# EasyEDA Pro project 第十四届蓝桥杯EDA国赛练习2.eprj, board PCB
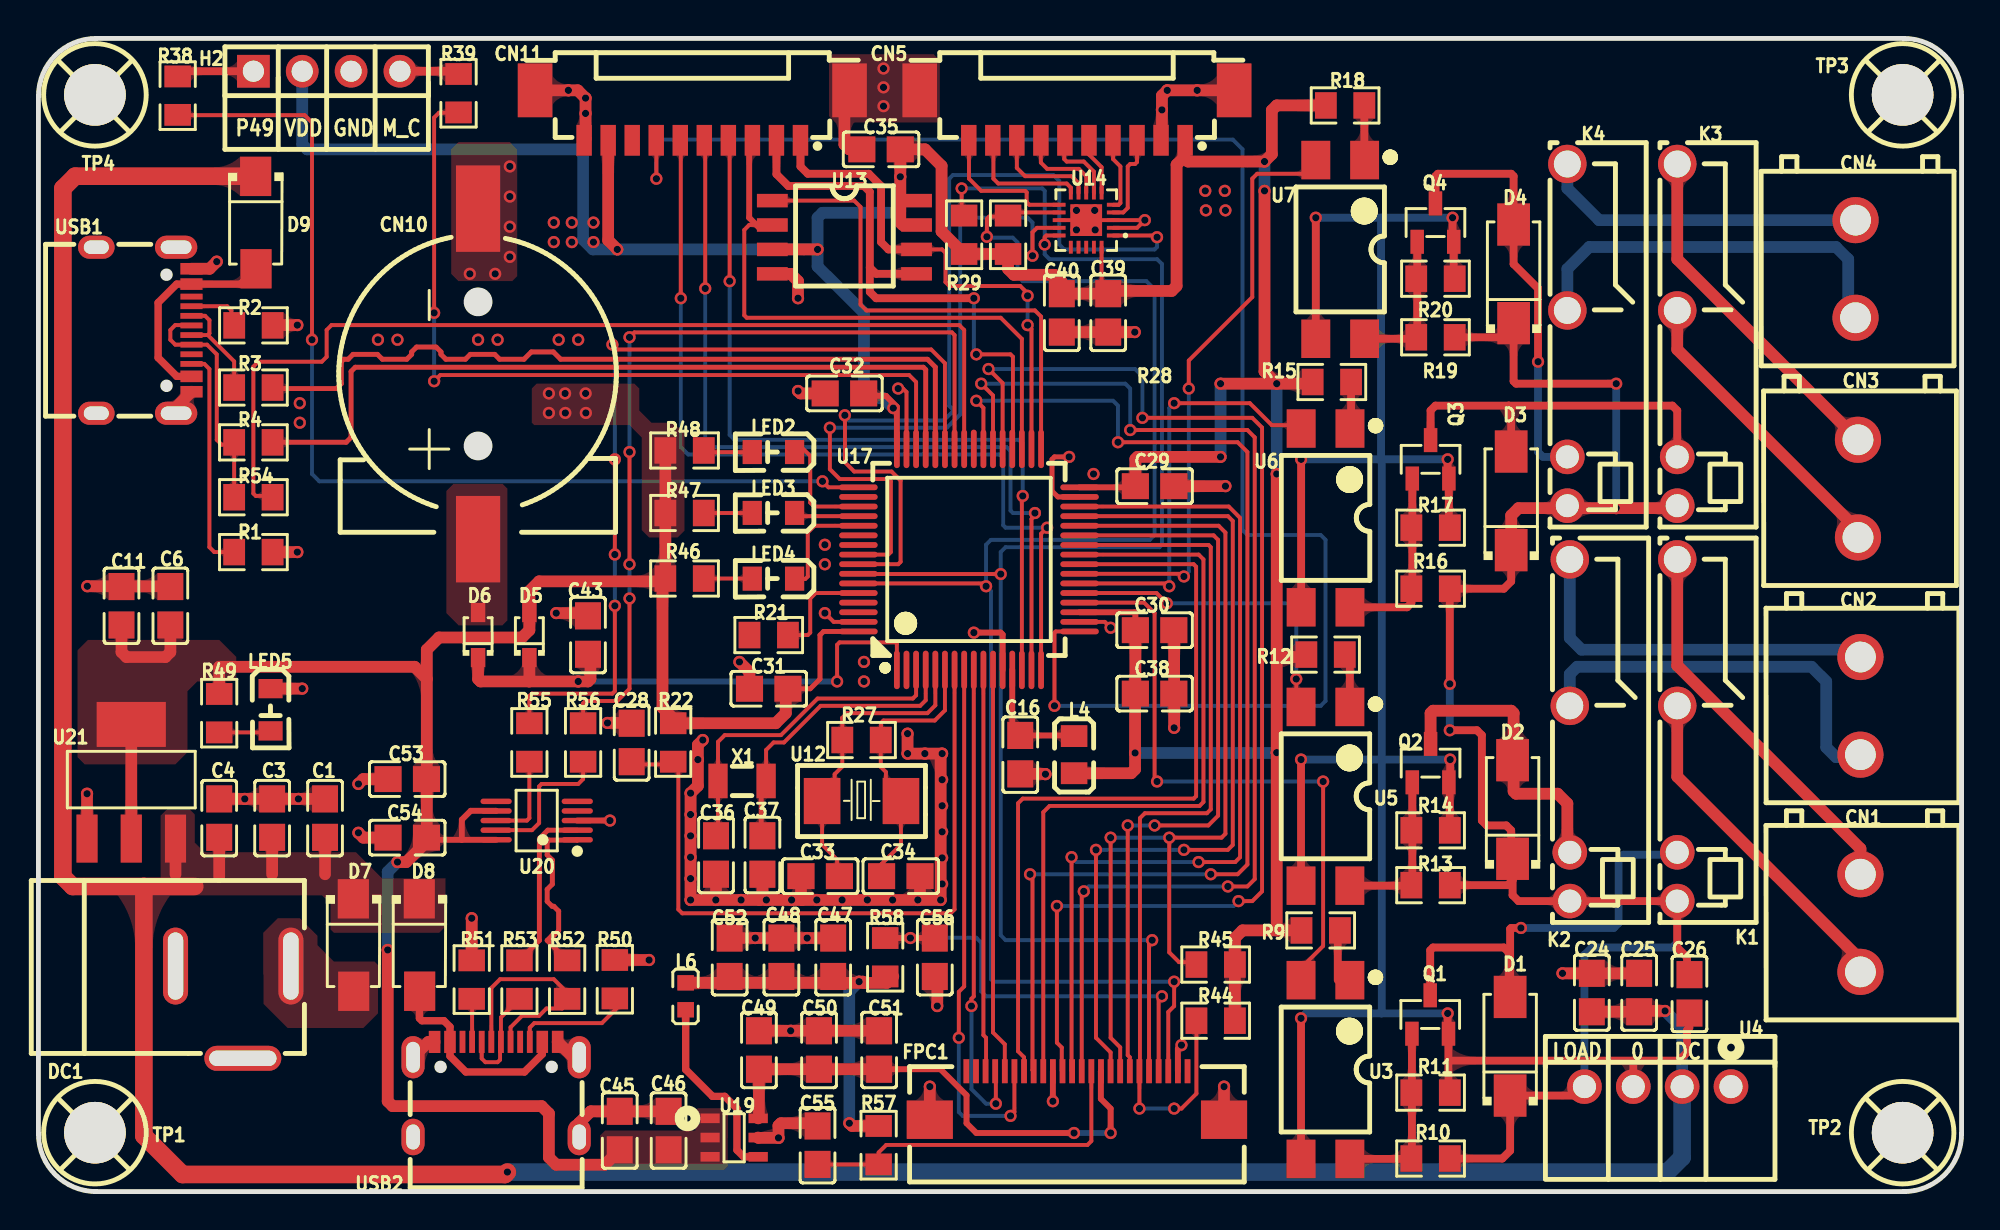
[diagram p3: board, top side]
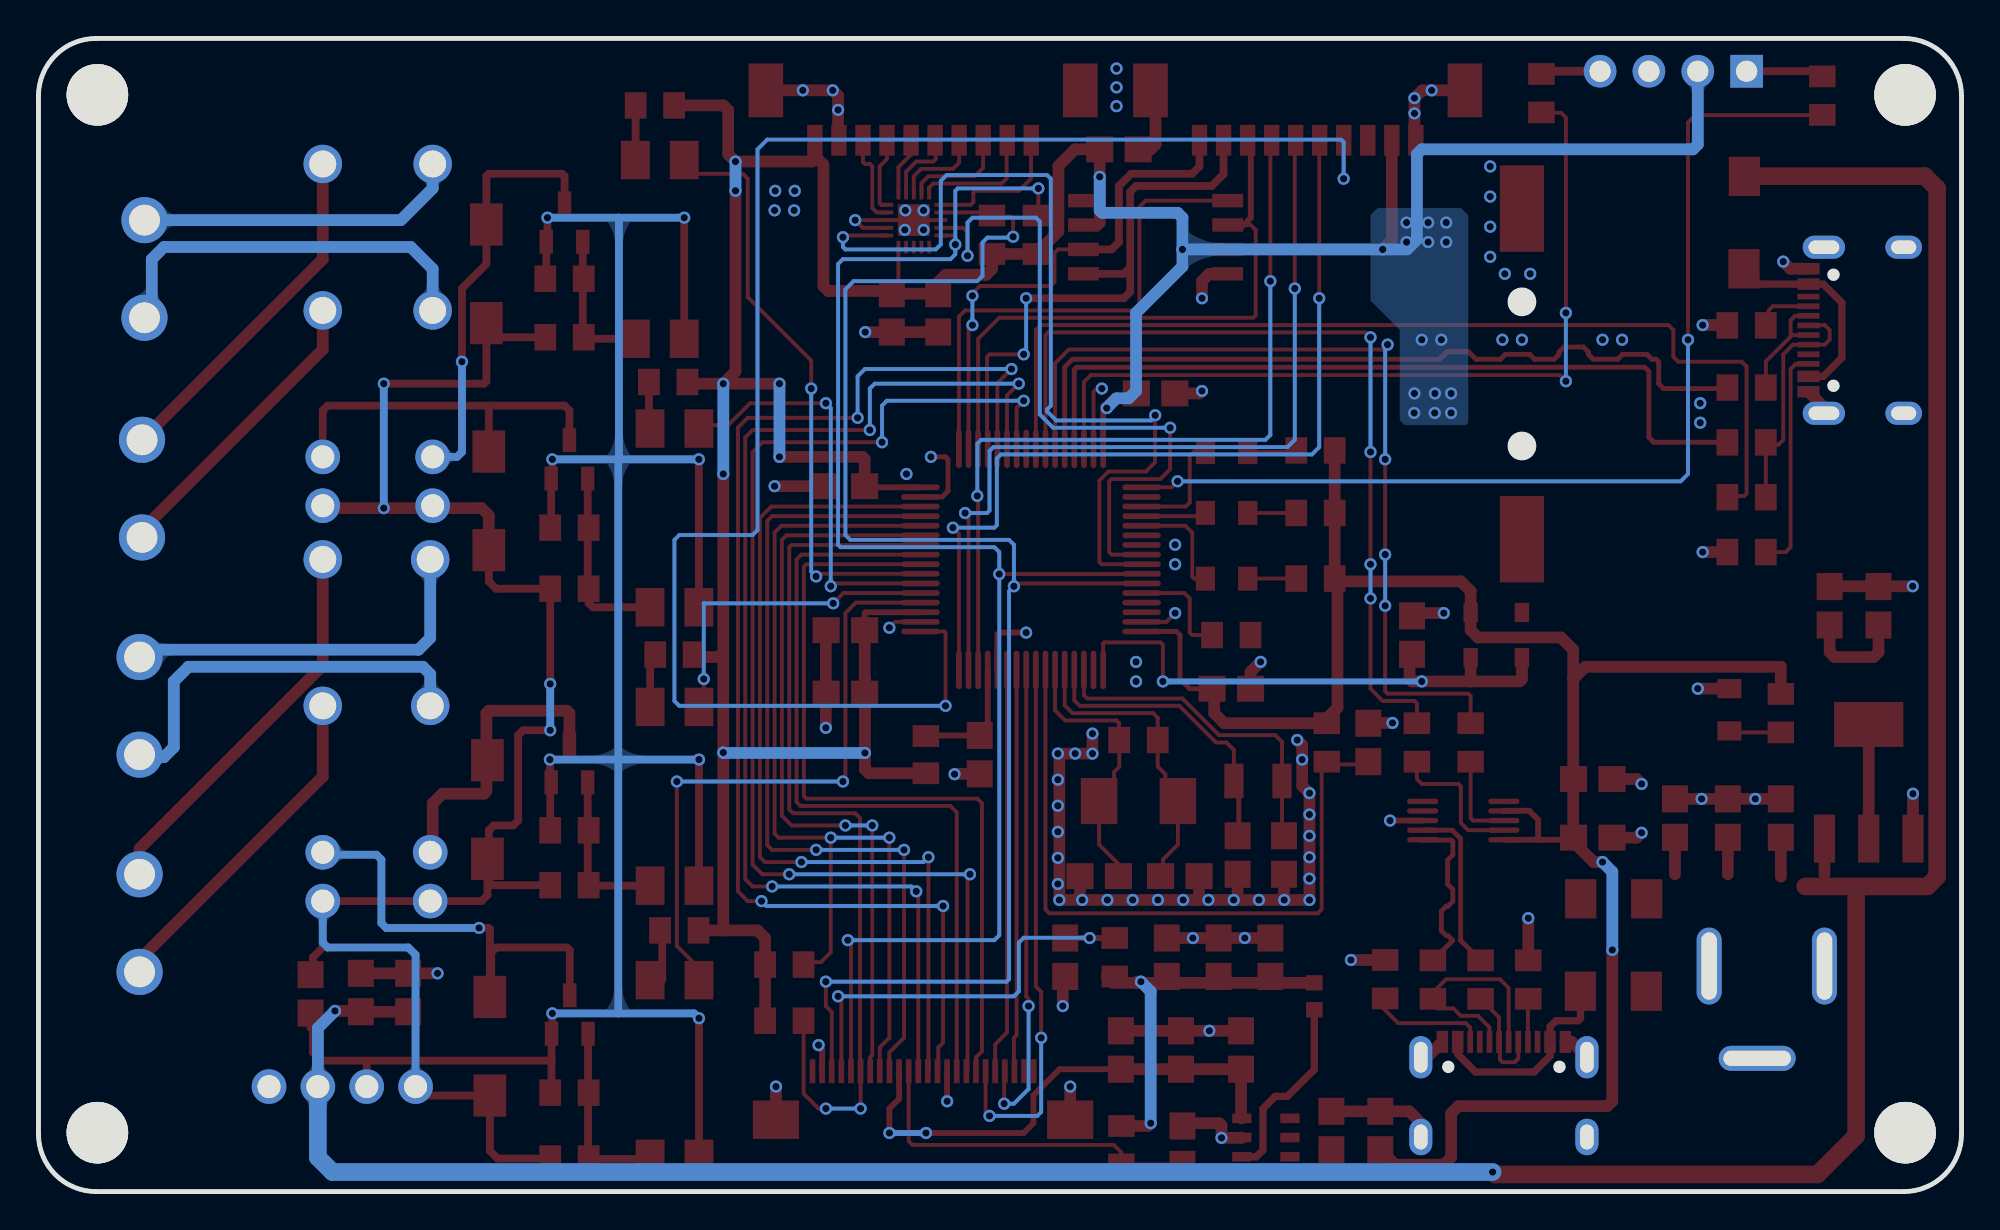
[diagram p4: board, bottom side, seen from below]

Outline 100 x 60 mm; copper layers: Top Layer, Bottom Layer. Coordinates in mm from the lower left corner of the outline.
Outline path: 0,57 arc(0.88,59.12) 3,60 97,60 arc(99.12,59.12) 100,57 100,3 arc(99.12,0.88) 97,0 3,0 arc(0.88,0.88) 0,3 0,57
Stack: Top Layer 0.035mm - / Dielectric1 1.51mm FR4 er 4.5 / Bottom Layer 0.035mm -

## Design rules (mm)
net USB_DN1: DP1
net USB_DP1: DP1
net USB_DP2: DP2
net USB_DN2: DP2
template: 自定义配置
spacing copperThickness1oz (default): track to track 0.178, other pairs 0.152 to 0.203
spacing copperThickness2oz: track to track 0.203, other pairs 0.152 to 0.3
track width copperThickness1oz (default): min 0.203, default 0.203, max 2.54
track width copperThickness2oz: min 0.203, default 0.254, max 2.54
track width PWR: min 0.203, default 0.61, max 2.54
differential pair differentialPair (default): width min 0.127, default 0.254, max 2.54; gap min 0.152, default 0.152
via viaSize (default): diameter min 0.635, default 0.635, max 10; hole min 0.381, default 0.381, max 6.299
net GND uses PWR
net DC uses PWR
net VDD uses PWR
net +2V8 uses PWR
net +1V5 uses PWR
net VDDA uses PWR

## Placement (name value [footprint] x y rotation side)
C1  10uF  [C0805]  14.9 19.43 270 top
C3  10uF  [C0805]  12.15 19.43 270 top
C4  100nF  [C0805]  9.4 19.43 270 top
C6  100nF  [C0805]  6.86 30.48 270 top
C11  10uF  [C0805]  4.32 30.48 270 top
C16  0.1u  [C0805]  51.05 22.73 90 top
C24  4.7uF  [C0805]  80.78 10.36 270 top
C25  4.7uF  [C0805]  83.24 10.36 270 top
C26  10uF  [C0805]  85.85 10.29 270 top
C28  100nF  [C0805]  30.85 23.37 90 top
C29  100nF  [C0805]  58.04 36.7 0 top
C30  100nF  [C0805]  58.04 29.21 0 top
C31  100nF  [C0805]  37.97 26.16 180 top
C32  100nF  [C0805]  41.91 41.53 180 top
C33  20p  [C0805]  40.65 16.41 0 top
C34  20p  [C0805]  44.84 16.41 180 top
C35  100nF  [C0805]  43.81 54.23 0 top
C36  20p  [C0805]  35.23 17.51 90 top
C37  20p  [C0805]  37.65 17.51 90 top
C38  100nF  [C0805]  58.04 25.91 0 top
C39  10uF  [C0805]  55.63 45.72 270 top
C40  100nF  [C0805]  53.21 45.72 90 top
C43  100nF  [C0805]  28.57 28.96 90 top
C45  10uF  [C0805]  30.23 3.18 270 top
C46  10uF  [C0805]  32.77 3.18 270 top
C47  10uF  [C0805]  41.32 12.19 270 top
C48  10uF  [C0805]  38.63 12.19 270 top
C49  10uF  [C0805]  37.47 7.37 90 top
C50  10uF  [C0805]  40.59 7.37 90 top
C51  100nF  [C0805]  43.71 7.37 90 top
C52  100nF  [C0805]  35.94 12.19 270 top
C53  100nF  [C0805]  19.18 21.46 180 top
C54  100nF  [C0805]  19.18 18.42 0 top
C55  10u  [C0805]  40.51 2.41 270 top
C56  10u  [C0805]  46.61 12.19 270 top
CN1  KF128L-5.08-2P蓝色  [TH_KF128L-5.08-2P]  94.74 13.97 90 top
CN2  KF128L-5.08-2P蓝色  [TH_KF128L-5.08-2P]  94.74 25.27 90 top
CN3  KF128L-5.08-2P蓝色  [TH_KF128L-5.08-2P]  94.62 36.58 90 top
CN4  KF128L-5.08-2P蓝色  [TH_KF128L-5.08-2P]  94.49 48.01 90 top
CN5  KH-A1251WF-10A  [CONN_SMD_10P-P1.25_KINGHELM_KH-A1251WF-10A]  54 56 180 top
CN10  CR1220_B  [BAT-SMD_CR1220-2ZX]  22.86 42.55 90 top
CN11  KH-A1251WF-10A  [CONN_SMD_10P-P1.25_KINGHELM_KH-A1251WF-10A]  34 56 180 top
D1  SS14  [SMA_L4.2-W2.6-LS5.3-RD]  76.53 7.56 90 top
D2  SS14  [SMA_L4.2-W2.6-LS5.3-RD]  76.65 19.88 90 top
D3  SS14  [SMA_L4.2-W2.6-LS5.3-RD]  76.58 35.94 90 top
D4  SS14  [SMA_L4.2-W2.6-LS5.3-RD]  76.71 47.75 90 top
D5  1N4148WS  [SOD-323_L1.8-W1.3-LS2.5-RD]  25.53 28.96 90 top
D6  1N4148WS  [SOD-323_L1.8-W1.3-LS2.5-RD]  22.86 28.96 90 top
D7  SS34  [SMA_L4.3-W2.6-LS5.0-RD]  16.38 12.83 270 top
D8  SS34  [SMA_L4.3-W2.6-LS5.0-RD]  19.81 12.83 270 top
D9  SS34  [SMA_L4.3-W2.6-LS5.0-RD]  11.3 50.42 270 top
DC1  -  [DC-2.0]  10 12 180 top
FPC1  F-FPC0M24P-C310  [FPC-SMD_P0.50-24P_XJ-FGS]  54 5 180 top
H2  2.54-1*4P母  [HDR-TH_4P-P2.54-V-F]  14.99 58.29 0 top
K1  HF49FD/012-1H12  [RELAY-TH_HF49FD-XXX-1H12-XXX]  85.22 24 90 top
K2  HF49FD/012-1H12  [RELAY-TH_HF49FD-XXX-1H12-XXX]  79.63 24 90 top
K3  HF49FD/012-1H12  [RELAY-TH_HF49FD-XXX-1H12-XXX]  85.22 44.58 90 top
K4  HF49FD/012-1H12  [RELAY-TH_HF49FD-XXX-1H12-XXX]  79.5 44.58 90 top
L4  10uH  [L0805]  53.85 22.73 90 top
L6  BLM18AG601SN1D  [L0603]  33.66 10.16 90 top
LED2  -  [LED_0805]  38.17 38.48 180 top
LED3  -  [LED_0805]  38.17 35.32 180 top
LED4  -  [LED_0805]  38.17 31.9 180 top
LED5  -  [LED_0805]  12.06 25.02 270 top
Q1  SS8050  [SOT-23-3_L2.9-W1.3-P1.90-LS2.4-BR]  72.37 9.21 270 top
Q2  SS8050  [SOT-23-3_L2.9-W1.3-P1.90-LS2.4-BR]  72.39 22.29 270 top
Q3  SS8050  [SOT-23-3_L2.9-W1.3-P1.90-LS2.4-BR]  72.39 38.1 270 top
Q4  SS8050  [SOT-23-3_L2.9-W1.3-P1.90-LS2.4-BR]  72.64 50.42 270 top
R1  5.1K  [R0805]  11.18 33.27 0 top
R2  5.1K  [R0805]  11.18 45.07 0 top
R3  22R  [R0805]  11.18 41.84 0 top
R4  22R  [R0805]  11.18 38.98 0 top
R9  10kΩ  [R0805]  66.68 13.59 0 top
R10  10kΩ  [R0805]  72.39 1.72 0 top
R11  10kΩ  [R0805]  72.39 5.15 180 top
R12  10kΩ  [R0805]  66.93 27.94 0 top
R13  10kΩ  [R0805]  72.39 15.94 0 top
R14  10kΩ  [R0805]  72.39 18.8 180 top
R15  10kΩ  [R0805]  67.25 42.12 0 top
R16  10kΩ  [R0805]  72.39 31.37 0 top
R17  10kΩ  [R0805]  72.39 34.54 180 top
R18  10kΩ  [R0805]  67.94 56.52 0 top
R19  10kΩ  [R0805]  72.64 44.45 0 top
R20  10kΩ  [R0805]  72.64 47.5 180 top
R21  10K  [R0805]  37.97 28.96 0 top
R22  10K  [R0805]  33.01 23.37 90 top
R27  1M  [R0805]  42.8 23.5 0 top
R28  10kΩ  [R0805]  50.42 49.78 270 top
R29  10kΩ  [R0805]  48.13 49.78 90 top
R38  100R  [R0805]  7.24 57.02 270 top
R39  100R  [R0805]  21.84 57.15 270 top
R44  10K  [R0805]  61.21 8.89 0 top
R45  10K  [R0805]  61.21 11.81 0 top
R46  300R  [R0805]  33.6 31.9 0 top
R47  300R  [R0805]  33.6 35.31 0 top
R48  300R  [R0805]  33.6 38.56 0 top
R49  510R  [R0805]  9.4 24.89 90 top
R50  5.1K  [R0805]  29.97 11.05 90 top
R51  5.1K  [R0805]  22.53 11.03 90 top
R52  22R  [R0805]  27.49 11.03 90 top
R53  22R  [R0805]  25.01 11.03 90 top
R54  1.5K  [R0805]  11.18 36.13 0 top
R55  300R  [R0805]  25.53 23.37 90 top
R56  300R  [R0805]  28.32 23.37 90 top
R57  0R  [R0805]  43.69 2.41 90 top
R58  0R  [R0805]  44.03 12.19 270 top
TP1  -  [M3螺丝]  3 3 0 top
TP2  -  [M3螺丝]  97 3 0 top
TP3  -  [M3螺丝]  97 57 0 top
TP4  -  [M3螺丝]  3 57 0 top
U3  TLP521-1XSM  [SMD-4_L4.6-W6.5-P2.54-LS10.2-BL]  66.92 6.35 180 top
U4  B0505S-1WR3  [PWRM-TH_B0503S-1WR3]  84.2 5.46 180 top
U5  TLP521-1XSM  [SMD-4_L4.6-W6.5-P2.54-LS10.2-BL]  66.92 20.57 180 top
U6  TLP521-1XSM  [SMD-4_L4.6-W6.5-P2.54-LS10.2-BL]  66.93 35.05 180 top
U7  TLP521-1XSM  [SMD-4_L4.6-W6.5-P2.54-LS10.2-BL]  67.69 49.02 180 top
U12  8M-5032-2P  [CRYSTAL-SMD_L5.0-W3.2]  42.8 20.32 180 top
U13  GD25Q16CSAG-SOP8_208MIL  [SOP-8_L5.2-W5.3-P1.27-LS7.9-BL]  41.91 49.66 270 top
U14  MDC04  [QFN-20_L3.0-W3.0-P0.40-BL-EP1.7]  54.48 50.55 90 top
U17  GD32F103RCT6  [LQFP-64_L10.0-W10.0-P0.50-LS12.0-BL]  48.39 32.89 0 top
U19  -  [SOT_DPV]  34.93 3.81 0 top
U20  CH340E  [MSOP-10_L3.0-W3.0-P0.50-LS5.0-BL]  25.91 19.3 90 top
U21  AMS1117-3.3  [SOT-223-3_L6.5-W3.4-P2.30-LS7.0-BR]  4.83 21.34 270 top
USB1  CQ-USB-TYPE-C16P母座四脚插板有柱  [USB-C-SMD_CQ-USB-TYPE-C]  5.48 44.82 270 top
USB2  CQ-USB-TYPE-C16P母座四脚插板有柱  [USB-C-SMD_CQ-USB-TYPE-C]  23.8 5.31 0 top
X1  32.768kHz  [FC-135R_L3.2-W1.5]  36.59 21.36 180 top

## Footprints (pads in the part's own frame, mm; a bottom-side part is the same pattern mirrored in y, then rotated)
BAT-SMD_CR1220-2ZX
  rect 4.5x2.3 smd: 1(-8.6,0) 2(8.6,0)
C0805
  rect 1.41x1.35 smd: 1(-1,0) 2(1,0)
CONN_SMD_10P-P1.25_KINGHELM_KH-A1251WF-10A
  rect 0.8x1.6 smd: 1(-5.625,1.3) 2(-4.375,1.3) 3(-3.125,1.3) 4(-1.875,1.3) 5(-0.625,1.3) 6(0.625,1.3) 7(1.875,1.3) 8(3.124,1.3) 9(4.375,1.3) 10(5.625,1.3)
  rect 1.8x2.8 smd: 11(8.175,-1.3) 12(-8.175,-1.3)
CRYSTAL-SMD_L5.0-W3.2
  rect 1.9x2.4 smd: 1(-2.05,0) 2(2.05,0)
DC-2.0
  oval 4x1.3 hole 3.5x0.8: 2(-0.627,5.067)
  oval 1.3x4 hole 0.8x3.5: 3(2.873,0.267) 4(-3.127,0.267)
FC-135R_L3.2-W1.5
  rect 1x1.8 smd: 1(-1.25,0) 2(1.25,0)
FPC-SMD_P0.50-24P_XJ-FGS
  rect 0.3x1.25 smd: 1(-5.752,-1.262) 2(-5.25,-1.262) 3(-4.75,-1.262) 4(-4.25,-1.262) 5(-3.75,-1.262) 6(-3.25,-1.262) 7(-2.75,-1.262) 8(-2.25,-1.262) 9(-1.75,-1.262) 10(-1.25,-1.262) 11(-0.75,-1.262) 12(-0.25,-1.262) 13(0.25,-1.262) 14(0.75,-1.262) 15(1.25,-1.262) 16(1.75,-1.262) 17(2.25,-1.262) 18(2.75,-1.262) 19(3.25,-1.262) 20(3.75,-1.262) 21(4.25,-1.262) 22(4.75,-1.262) 23(5.25,-1.262) 24(5.75,-1.262)
  rect 2.4x2 smd: 25(-7.65,1.262) 26(7.65,1.262)
HDR-TH_4P-P2.54-V-F
  rect 1.7x1.7 hole 1.1: 1(-3.81,0)
  round 1.7 hole 1.1: 2(-1.27,0) 3(1.27,0) 4(3.81,0)
L0603
  rect 0.8x0.864 smd: 1(-0.7,0) 2(0.7,0)
L0805
  rect 1.133x1.377 smd: 1(-0.966,0) 2(0.966,0)
LED_0805
  rect 1x1.25 smd: 1(-1.15,0.005) 2(1.05,0.005)
LQFP-64_L10.0-W10.0-P0.50-LS12.0-BL
  oval 0.3x2 smd: 1(-3.75,-5.75) 2(-3.25,-5.75) 3(-2.75,-5.75) 4(-2.25,-5.75) 5(-1.75,-5.75) 6(-1.25,-5.75) 7(-0.75,-5.75) 8(-0.25,-5.75) 9(0.25,-5.75) 10(0.75,-5.75) 11(1.25,-5.75) 12(1.75,-5.75) 13(2.25,-5.75) 14(2.75,-5.75) 15(3.25,-5.75) 16(3.75,-5.75) 33(3.75,5.75) 34(3.25,5.75) 35(2.75,5.75) 36(2.25,5.75) 37(1.75,5.75) 38(1.25,5.75) 39(0.75,5.75) 40(0.25,5.75) 41(-0.25,5.75) 42(-0.75,5.75) 43(-1.25,5.75) 44(-1.75,5.75) 45(-2.25,5.75) 46(-2.75,5.75) 47(-3.25,5.75) 48(-3.75,5.75)
  oval 2x0.3 smd: 17(5.75,-3.75) 18(5.75,-3.25) 19(5.75,-2.75) 20(5.75,-2.25) 21(5.75,-1.75) 22(5.75,-1.25) 23(5.75,-0.75) 24(5.75,-0.25) 25(5.75,0.25) 26(5.75,0.75) 27(5.75,1.25) 28(5.75,1.75) 29(5.75,2.25) 30(5.75,2.75) 31(5.75,3.25) 32(5.75,3.75) 49(-5.75,3.75) 50(-5.75,3.25) 51(-5.75,2.75) 52(-5.75,2.25) 53(-5.75,1.75) 54(-5.75,1.25) 55(-5.75,0.75) 56(-5.75,0.25) 57(-5.75,-0.25) 58(-5.75,-0.75) 59(-5.75,-1.25) 60(-5.75,-1.75) 61(-5.75,-2.25) 62(-5.75,-2.75) 63(-5.75,-3.25) 64(-5.75,-3.75)
M3螺丝
  round 3.2 hole 3.2: 1(-0.064,0.064)
MSOP-10_L3.0-W3.0-P0.50-LS5.0-BL
  oval 0.28x1.62 smd: 1(-1,-2.11) 2(-0.5,-2.11) 3(0,-2.11) 4(0.5,-2.11) 5(1,-2.11) 6(1,2.11) 7(0.5,2.11) 8(0,2.11) 9(-0.5,2.11) 10(-1,2.11)
PWRM-TH_B0503S-1WR3
  round 1.8 hole 1.2: 1(-3.81,0) 2(-1.27,0) 3(1.27,0) 4(3.81,0)
QFN-20_L3.0-W3.0-P0.40-BL-EP1.7
  rect 0.2x0.665 smd: 1(-0.8,-1.407) 2(-0.4,-1.407) 3(0,-1.407) 4(0.4,-1.407) 5(0.8,-1.407) 11(0.8,1.407) 12(0.4,1.407) 13(0,1.407) 14(-0.4,1.407) 15(-0.8,1.407)
  rect 0.665x0.2 smd: 6(1.407,-0.8) 7(1.407,-0.4) 8(1.407,0) 9(1.407,0.4) 10(1.407,0.8) 16(-1.407,0.8) 17(-1.407,0.4) 18(-1.407,0) 19(-1.407,-0.4) 20(-1.407,-0.8)
  rect 1.65x1.65 smd: 21(0,0)
R0805
  rect 1.133x1.377 smd: 1(-1,0) 2(1,0)
RELAY-TH_HF49FD-XXX-1H12-XXX
  round 1.8 hole 1.2: 1(-8.89,0) 2(-6.35,0)
  round 2 hole 1.4: 3(1.27,0) 4(8.89,0)
SMA_L4.2-W2.6-LS5.3-RD
  rect 2.2x1.7 smd: 1(-2.566,0) 2(2.566,0)
SMA_L4.3-W2.6-LS5.0-RD
  rect 2.046x1.62 smd: 1(-2.404,-0.009) 2(2.404,0.009)
SMD-4_L4.6-W6.5-P2.54-LS10.2-BL
  rect 1.5x2 smd: 1(-1.27,-4.65) 2(1.27,-4.65) 3(1.27,4.65) 4(-1.27,4.65)
SOD-323_L1.8-W1.3-LS2.5-RD
  rect 1x0.75 smd: 1(-1.173,0) 2(1.173,0)
SOP-8_L5.2-W5.3-P1.27-LS7.9-BL
  rect 0.7x1.6 smd: 1(-1.905,-3.75) 2(-0.635,-3.75) 3(0.635,-3.75) 4(1.905,-3.75) 5(1.905,3.75) 6(0.635,3.75) 7(-0.635,3.75) 8(-1.905,3.75)
SOT-23-3_L2.9-W1.3-P1.90-LS2.4-BR
  rect 1.25x0.7 smd: 1(1,-0.95) 2(1,0.95) 3(-1,0)
SOT-223-3_L6.5-W3.4-P2.30-LS7.0-BR
  rect 2.5x1.1 smd: 1(2.97,-2.3) 2(2.97,0) 3(2.97,2.3)
  rect 2.34x3.6 smd: 4(-2.97,0)
SOT_DPV
  rect 1x0.5 smd: 1(0,0) 2(0,-1) 3(0,-2) 4(2.5,-2) 5(2.5,-1) 6(2.5,0)
TH_KF128L-5.08-2P
  round 2.4 hole 1.6: 1(-2.54,0) 2(2.54,0)
USB-C-SMD_CQ-USB-TYPE-C
  oval 1.2x2.2 hole 0.7x1.6: 0(-4.32,1.675) 0(4.32,1.675)
  oval 1.2x1.9 hole 0.7x1.3: 0(-4.32,-2.475) 0(4.32,-2.475)
  rect 0.6x1.15 smd: A1B12(-3.2,2.471) A4B9(-2.4,2.471) B1A12(3.2,2.475) B4A9(2.4,2.475)
  rect 0.3x1.15 smd: A5(-1.25,2.475) A6(-0.25,2.475) A7(0.25,2.474) A8(1.25,2.475) B5(1.75,2.475) B6(0.75,2.475) B7(-0.75,2.473) B8(-1.75,2.475)

## Nets
As in the schematic.

Pads without a net: CN11 8; FPC1 1 23 24; U14 16 17 18 19; U17 2 40 50 54 55 61 62; U20 4 5 6; USB1 A8 B8; USB2 A8 B8

## Via types
v1: diameter 0.635, hole 0.381, Top Layer to Bottom Layer, 220 vias

## Routing (per net, layer and track width the routed paths; a pad name or vN(x,y) marks a point on that pad's centre or on a via; arc(x,y) is an arc through that point)
+1V5: length 26
  Top Layer w0.305: v1(53.85,3.05) 48.77,3.05 48.26,3.56 48.26,5.01 46.9,6.37 C51.1 ; v1(55.75,3.05) 55.75,4.32 55.25,4.83 55.25,6.26 FPC1.10
  Top Layer w0.61: C49.1 C50.1 C51.1 ; 37.47,5.86 37.47,3.85 U19.6
  Bottom Layer w0.305: v1(55.75,3.05) v1(53.85,3.05)
+2V8: length 20.4
  Top Layer w0.61: v1(42.67,10.92) 42.86,10.92 42.93,10.86 ; 42.93,10.86 L6.2 ; 42.93,10.86 44.12,10.86 44.45,11.19 ; R57.2 42.31,3.41 v1(42.16,3.56)
  Bottom Layer w0.61: v1(42.67,10.92) 42.16,10.41 v1(42.16,3.56)
GND: length 159.4
  Top Layer w0.203: v1(44.7,41.78) 44.96,41.78 45.14,41.6 U17.47 ; U17.63 41.35,29.64 v1(40.89,30.1) ; U17.18 55.45,29.64 v1(55.75,29.34) ; U14.13 U14.21 U14.3 v1(57.53,50.55) 57.13,50.15 U14.2
  Top Layer w0.254: v1(53.59,38.23) 52.83,38.23 52.71,38.1 52.71,36.45 53.01,36.14 U17.31
  Top Layer w0.305: U17.12 50.14,28.98 50.04,29.08 v1(48.64,29.08) ; v1(59.44,7.62) 59.25,7.43 FPC1.2 ; FPC1.15 v1(52.75,4.7) ; U20.3 v1(29.72,19.3)
  Top Layer w0.61: v1(35.22,15.17) 35.23,15.18 C36.1 ; v1(35.22,15.17) v1(33.91,15.17) v1(33.91,16.28) v1(33.91,17.4) v1(33.91,18.51) v1(33.91,19.62) v1(33.91,20.73) 34.29,21.11 v1(34.29,22.48) 34.29,23.24 v1(34.54,23.5) ; v1(35.22,15.17) v1(36.54,15.17) 37.49,15.17 ; R51.2 v1(22.53,14.22) ; v1(36.45,27.56) 36.97,27.03 C31.2 ; CN11.10 28.45,54.77 v1(28.45,56.1) v1(28.45,56.9) 28.04,57.3 v1(27.55,57.3) CN11.11 ; FPC1.26 v1(46.35,5.46) ; FPC1.25 v1(61.65,5.46) ; CN5.12 v1(60.25,57.3) v1(58.7,57.3) 58.42,57.02 v1(58.42,56.28) 58.42,54.75 CN5.2 ; 39.71,15.17 v1(40.47,15.17) v1(41.79,15.17) v1(43.1,15.17) v1(44.41,15.17) v1(45.73,15.17) ; 39.71,15.17 v1(39.16,15.17) v1(37.85,15.17) 37.49,15.17 ; 39.71,15.17 39.65,15.23 C33.1 ; C47.1 v1(39.97,13.19) C48.1 v1(37.27,13.19) C52.1 ; 37.49,15.17 37.65,15.33 C37.1 ; C43.2 28.43,30.1 v1(26.92,30.1) ; C1.1 v1(13.52,20.43) C3.1 v1(10.73,20.43) C4.1 ; v1(79.25,11.36) C24.1 C25.1 ; v1(39.5,46.48) 39.5,47.37 39.12,47.75 U13.4 ; C55.1 40.37,3.56 38.61,3.56 38.48,3.43 v1(38.48,2.79) 37.44,2.79 U19.5 ; 28.12,6.99 27.8,6.99 USB2.B1A12 ; C28.2 30.83,24.38 v1(29.59,24.38) ; R1.2 v1(13.46,33.27) ; C32.2 39.62,41.53 v1(39.5,41.66) ; C34.1 45.84,15.29 v1(45.73,15.17) ; CN11.12 41.91,57.03 41.91,54.48 42.16,54.23 C35.1 ; C29.2 v1(61.72,36.7) ; v1(46.74,9.65) 46.74,11.06 C56.2 ; C53.2 16.89,21.46 v1(16.64,21.21) ; 4.3,31.5 C11.1 ; 4.3,31.5 v1(2.54,31.5) ; 4.3,31.5 6.84,31.5 C6.1 ; v1(59.06,24.13) 59.06,29.32 59.04,29.34 C30.2 ; R50.2 v1(31.75,12.05) ; C46.1 C45.1 28.72,4.18 28.12,3.57 USB2.0 ; v1(45.19,23.83) v1(45.19,22.79) v1(46.09,22.79) v1(46.99,22.79) 46.91,22.71 v1(46.91,15.17) v1(45.73,15.17) ; v1(52.36,21.72) 52.35,21.73 C16.1 ; v1(57.01,44.72) C39.2 C40.1 ; v1(13.46,45.08) 12.19,45.08 R2.2 ; USB1.0 7.16,40.82 USB1.B1A12 ; C49.2 v1(39.11,8.37) C50.2 40.59,8.33 40.62,8.37 C51.2 ; 12.07,26.17 v1(13.72,26.17) ; C54.1 16.89,18.42 v1(16.64,18.67) ; 19.48,6.99 20.28,7.79 USB2.A1B12 ; USB1.A1B12 8.9,48.02 v1(9.27,48.39) ; U21.1 v1(2.53,20.7)